# EAGLE board yrl040-bugfix1 (EAGLE 9.4.2), part 1 of 2
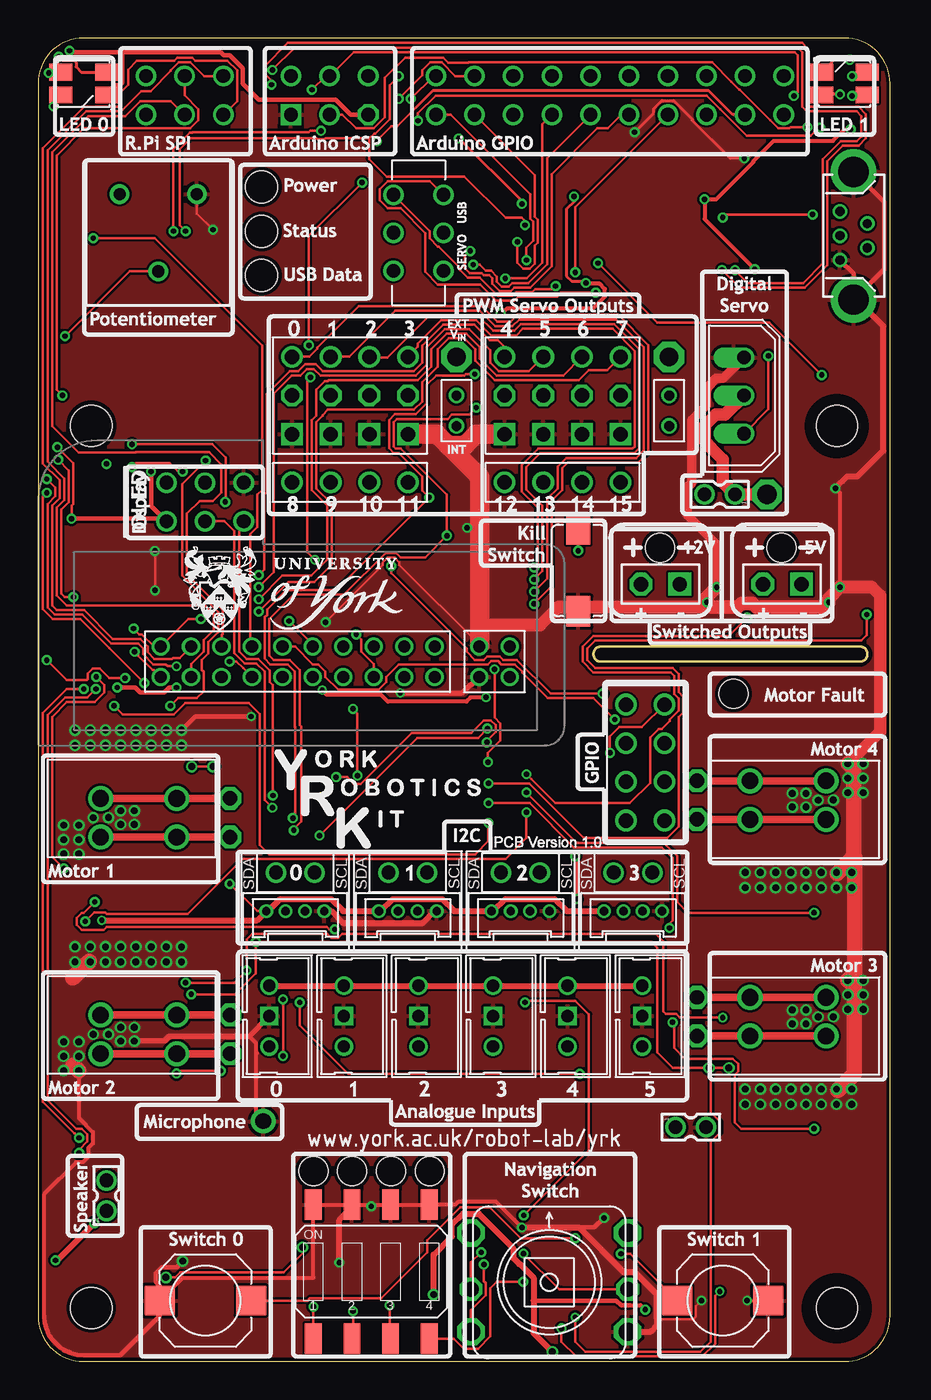
[diagram p4: board, top side]
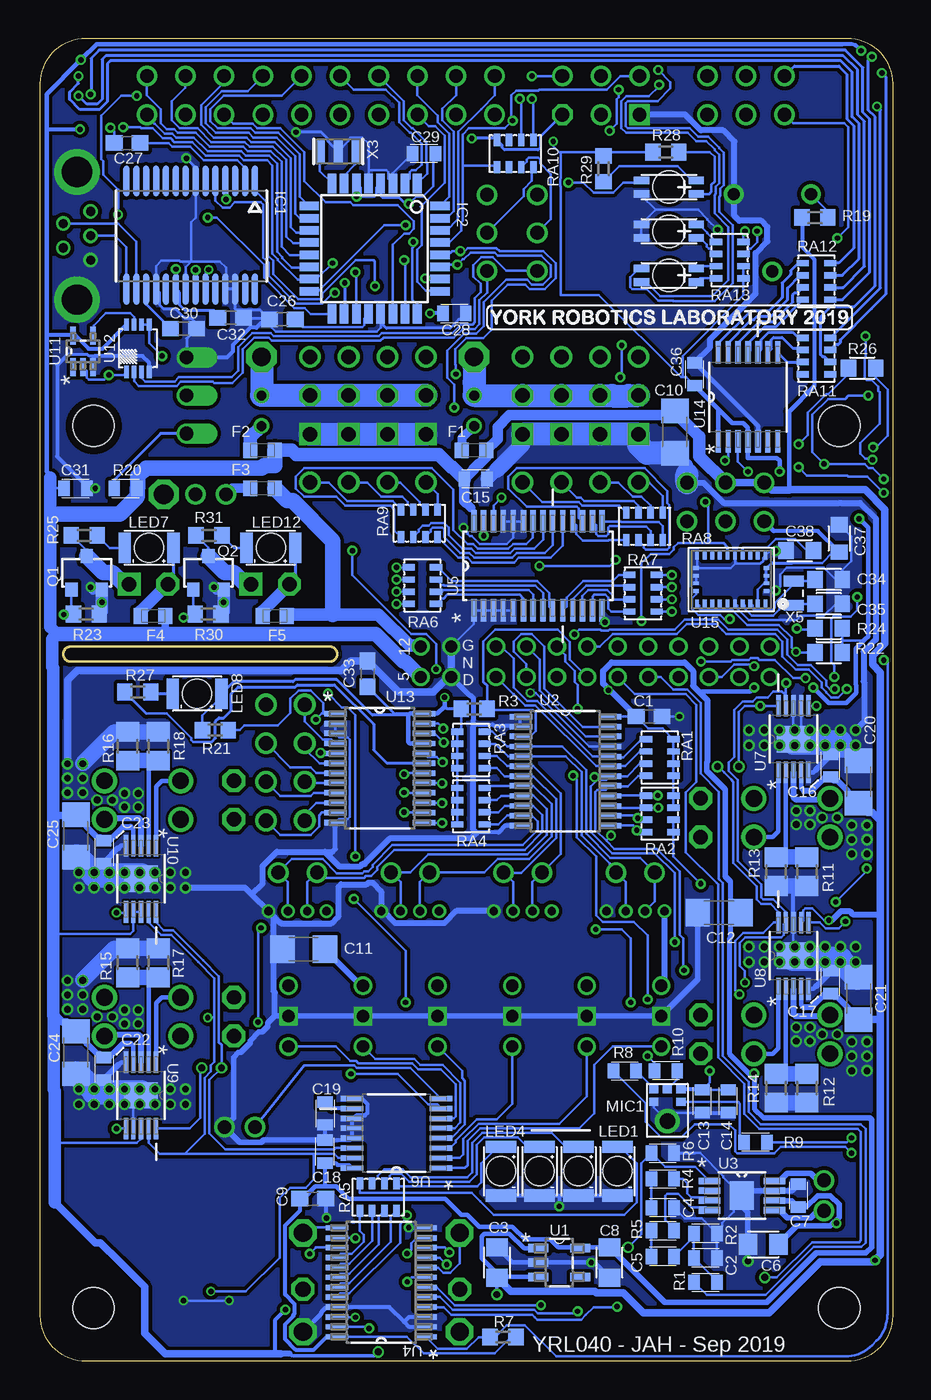
[diagram p5: board, bottom side, seen from below]

Size 56 x 87 mm. Coordinates in mm from the lower left corner, seen from the top.
Outline: 53,0 arc90 56,3 56,84 arc90 53,87 3,87 arc90 0,84 0,3 arc90 3,0 53,0
Outline: 37,46 54,46 arc180 54,47 37,47 arc180 37,46
Copper layers (1*16): Top 0.018mm / dielectric 1.55mm / Bottom 0.018mm
Design rules "eC_2Layer_PClass6_BaseCopperO18_eCDefault": minimum track width 0.15mm, minimum drill 0.35mm, track to track 0.15mm, track to pad 0.15mm, pad to pad 0.15mm, via to via 0.15mm, smd to smd 0mil, copper to edge 0.25mm, drill to drill 0.35mm, minimum pad ring 0.175mm, minimum via ring 0.125mm, stop-mask expansion 0mil, vias tented up to drill 0.45mm, thermal gap 0.2mm
Holes 2.7 mm at 3.5,61.5 3.5,3.5 52.5,3.5 52.5,61.5
bKeepout: area 39.8,0 to 49.2,14.6
tRestrict: area 2.2,2.2 to 4.8,4.8; area 2.7,60.7 to 4.3,62.3; area 51.5,60.5 to 53.5,62.5; area 51.3,2.3 to 53.7,4.7
bRestrict: area 51,1.9 to 54,5; area 2,2 to 5,5; area 51.7,60.7 to 53.3,62.3; area 1.9,59.9 to 5.1,63.1; area 1.9,1.9 to 5,5

## Footprints (pad centres in the part's own frame; a part is rotated, then mirrored left to right if it is on the bottom)
C0603 = smd 1.1 x 1: 1 -0.85,0; 2 0.85,0
0603-RESISTOR = smd 0.75 x 1: 1 -0.75,0; 2 0.75,0
0805 = smd 1.2 x 1.4: P$1 -1,0; P$2 1,0
C1206 = smd 1.6 x 1.8: 1 -1.4,0; 2 1.4,0
0603 = smd 1 x 1.1: P$1 -0.9,0; P$2 0.9,0
0603-1608X90N = smd 0.95 x 1: 1 -0.8,0; 2 0.8,0
SSOP28 = smd 0.381 x 2.032: 1 0,0; 2 0.65,0; 3 1.3,0; 4 1.95,0; 5 2.6,0; 6 3.25,0; 7 3.9,0; 8 4.55,0; 9 5.2,0; 10 5.85,0; 11 6.5,0; 12 7.15,0; 13 7.8,0; 14 8.45,0; 15 8.45,7.112; 16 7.8,7.112; 17 7.15,7.112; 18 6.5,7.112; 19 5.85,7.112; 20 5.2,7.112; 21 4.55,7.112; 22 3.9,7.112; 23 3.25,7.112; 24 2.6,7.112; 25 1.95,7.112; 26 1.3,7.112; 27 0.65,7.112; 28 0,7.112
TQFP32-08 = smd 1.27 x 0.559: 1 -4.293,2.8; 2 -4.293,2; 3 -4.293,1.2; 4 -4.293,0.4; 5 -4.293,-0.4; 6 -4.293,-1.2; 7 -4.293,-2; 8 -4.293,-2.8; 17 4.293,-2.8; 18 4.293,-2; 19 4.293,-1.2; 20 4.293,-0.4; 21 4.293,0.4; 22 4.293,1.2; 23 4.293,2; 24 4.293,2.8 | smd 0.559 x 1.27: 9 -2.8,-4.293; 10 -2,-4.293; 11 -1.2,-4.293; 12 -0.4,-4.293; 13 0.4,-4.293; 14 1.2,-4.293; 15 2,-4.293; 16 2.8,-4.293; 25 2.8,4.293; 26 2,4.293; 27 1.2,4.293; 28 0.4,4.293; 29 -0.4,4.293; 30 -1.2,4.293; 31 -2,4.293; 32 -2.8,4.293
CONNECTOR-PAIRS = drill 0.8: AUDIO -14.94,-1; AUDIO_ON -12.94,-1; CE0 -18.94,-1; CE1 -16.94,1; GND1 -2,-1; GND2 -2,1; GPIO5 -16.94,-1; GPIO6 -14.94,1; GPIO13 -12.94,1; GPIO21 -10.94,-1; I2S_B -10.94,1; I2S_D -8.94,1; I2S_W -8.94,-1; MISO -20.94,-1; MOSI -20.94,1; RXD -22.94,-1; SCL -6.94,1; SCL_UC -4.94,1; SCLK -18.94,1; SDA -6.94,-1; SDA_UC -4.94,-1; TXD -22.94,1; V5 0,-1; V12 0,1
PICOBLADE-4PIN-9733060-2 = drill 0.55 pad 0.9: GND_1 1.905,0; SCL_1 0.635,0; SDA_1 -0.635,0; V+_1 -1.905,0 | drill 0.9 pad 1.25: SCL_3 1.27,2.54; SDA_3 -1.27,2.54
YRL012-EXPORTED_I2C_PI_OLED = drill 0.9: 3V3 14.732,26.162; 5V-1 17.272,26.162; 5V-2 17.272,23.622; GND 17.272,21.082; SCL 14.732,21.082; SDA 14.732,23.622
SERVO_BLOCK_8X2 = drill 0.65 pad 1.016: +5V 7,-2; +5V1 20.97,-2; V_INT_JUMPER 7,0; V_INT_JUMPER1 20.97,0 | drill 0.95 square: GND1 -3.81,-2.54; GND2 -1.27,-2.54; GND3 1.27,-2.54; GND4 3.81,-2.54; GND5 10.16,-2.54; GND6 12.7,-2.54; GND7 15.24,-2.54; GND8 17.78,-2.54 | drill 0.95: PWM1 -3.81,2.54; PWM2 -1.27,2.54; PWM3 1.27,2.54; PWM4 3.81,2.54; PWM5 10.16,2.54; PWM6 12.7,2.54; PWM7 15.24,2.54; PWM8 17.78,2.54; PWM9 -3.81,-5.715; PWM10 -1.27,-5.715; PWM11 1.27,-5.715; PWM12 3.81,-5.715; PWM13 10.16,-5.715; PWM14 12.7,-5.715; PWM15 15.24,-5.715; PWM16 17.78,-5.715 | drill 0.95 octagon: V+1 -3.81,0; V+2 -1.27,0; V+3 1.27,0; V+4 3.81,0; V+5 10.16,0; V+6 12.7,0; V+7 15.24,0; V+8 17.78,0 | drill 1.2 pad 2 octagon: V_EXT 7,2.54; V_EXT1 20.97,2.54
WAGO-233-502 = drill 1.1 pad 1.5: P1-A -2.5,-1.27; P1-B 2.5,-1.27; P2-A -2.5,1.27; P2-B 2.5,1.27 | drill 0.95 pad 1.5 octagon: P1-C 6,-1.27; P2-C 6,1.27
JST-3PIN-PH = drill 0.8 pad 1.2: 1-VO 4,0; 3-VCC 0,0 | drill 0.8 pad 1.2 square: 2-GND 2,0
MINIUSB-VERT-1841175 = drill 0.6 pad 0.95: 1 0.9,-1.6; 2 -0.9,-0.8; 3 0.9,0; 4 -0.9,0.8; 5 0.9,1.6 | drill 2 pad 2.5: 6 0,-4.2; 7 0,4.2
2X10-PIN-ARDUINO = drill 0.9 pad 1.3: +3V3 20.32,-2.54; A0 0,-2.54; A1 2.54,-2.54; A2 5.08,-2.54; A3 7.62,-2.54; A4 10.16,-2.54; A5 12.7,-2.54; A6 15.24,-2.54; A7 17.78,-2.54; CE0 -16.51,0; CE1 -19.05,-2.54; D0 0,0; D1 2.54,0; D2 5.08,0; D3 7.62,0; D4 10.16,0; D5 12.7,0; D6 15.24,0; D7 17.78,0; D8 20.32,0; D9 22.86,0; D10 22.86,-2.54; D11 -6.985,-2.54; D12 -4.445,0; D13 -6.985,0; LED -19.05,0; MISO -13.97,0; MOSI -13.97,-2.54; RST -9.525,0; SCLK -16.51,-2.54 | drill 0.9 pad 1.3 octagon: +5V -4.445,-2.54 | drill 0.9 pad 1.3 square: GND -9.525,-2.54
VIN_PIN = drill 1.3 pad 1.9 octagon: P$1 0,0
MOLEX-3PIN-9979620 = drill 0.9 offset: P$1 0,0; P$2 0,-2.5; P$3 0,-5
4X2X0.1"-GPIO = drill 0.95 pad 1.422: GPIO0 -1.27,5.08; GPIO1 1.27,5.08; GPIO2 -1.27,2.54; GPIO3 1.27,2.54; GPIO4 -1.27,0; GPIO5 1.27,0; GPIO6 -1.27,-2.54; GPIO7 1.27,-2.54
2-PIN-SPO = drill 0.95 pad 1.5 octagon: V+ -1.27,0 | drill 0.95 pad 1.5 square: V- 1.27,0
KPTL-SERIES-REVERSE-SMD-LED = smd 0.8 x 2: ANODE -1.6,0; CATHODE 1.6,0 | hole 1.9: 0,0
2401105-RGB-LED = smd 1.1 x 1.5: 1 -0.75,-1.5; 2 -0.75,1.5; 3 0.75,1.5; 4 0.75,-1.5
SML-825X-SERIES = smd 1 x 0.5: 1-RED_ANODE 1.8,0.45; 2_RED-CATHODE -1.8,0.45; 3-GREEN-ANODE 1.8,-0.45; 4-GREEN-CATHODE -1.8,-0.45 | hole 2.1: 0,0
MICROBUILDER_SPH0645LM4H = smd 0.6 x 0.525: 1 -0.9,1.4; 2 -0.9,0.55; 4 0.9,0.55; 5 0.9,1.4; 6 0,1.4 | drill 1.025 pad 1.625: 3 0,-0.71
BSR802N-NMOS = smd 0.8 x 0.9: 1-G -1,-1.1; 2-S 1,-1.1; 3-D 0,1.1
R0603 = smd 1 x 1.1: 1 -0.85,0; 2 0.85,0
R0805 = smd 1.3 x 1.5: 1 -0.95,0; 2 0.95,0
1206-RES-ARRAY = smd 0.42 x 0.8: P$1 -1.2,-0.9; P$2 -0.4,-0.9; P$3 0.4,-0.9; P$4 1.2,-0.9; P$5 1.2,0.9; P$6 0.4,0.9; P$7 -0.4,0.9; P$8 -1.2,0.9
PSISWARM15LIBRARYPSI-SWARM-1-5_01-ROBOT_4WAYDIL-MCEMR-04-T = smd 1.1 x 2: 1 -3.81,-4.4; 2 -1.27,-4.4; 3 1.27,-4.4; 4 3.81,-4.4; 5 3.81,4.4; 6 1.27,4.4; 7 -1.27,4.4; 8 -3.81,4.4
PCB_SWITCH = smd 2 x 2: P$1 -3,0; P$2 3,0
PSISWARM15LIBRARYPSI-SWARM-1-5_01-ROBOT_ALPS-SKQUCAA010 = drill 1.2 octagon: P1 -5.15,3.25; P3 -5.15,-3.25; P4 5.15,-3.25; P6 5.15,3.25 | drill 1 octagon: P2 -5.15,-0.45; P5 5.15,-0.45
DPDT-SWITCH-2320018 = drill 0.9: A_1 -2.5,1.65; A_2 2.5,1.65; A_COM 0,1.65; B_1 -2.5,-1.65; B_2 2.5,-1.65; B_COM 0,-1.65
6X3.5-SWITCH = smd 2 x 1.6: 1 -2.7,0; 2 2.7,0
SOT95P270X145-5N = smd 1.321 x 0.559: 1 -1.372,0.94; 2 -1.372,0; 3 -1.372,-0.94; 4 1.372,-0.94; 5 1.372,0.94
SOP65P640X120-24N = smd 1.473 x 0.356: 1 -2.921,3.581; 2 -2.921,2.921; 3 -2.921,2.286; 4 -2.921,1.626; 5 -2.921,0.965; 6 -2.921,0.33; 7 -2.921,-0.33; 8 -2.921,-0.965; 9 -2.921,-1.626; 10 -2.921,-2.286; 11 -2.921,-2.921; 12 -2.921,-3.581; 13 2.921,-3.581; 14 2.921,-2.921; 15 2.921,-2.286; 16 2.921,-1.626; 17 2.921,-0.965; 18 2.921,-0.33; 19 2.921,0.33; 20 2.921,0.965; 21 2.921,1.626; 22 2.921,2.286; 23 2.921,2.921; 24 2.921,3.581
SOP65P488X107-9N = smd 1.397 x 0.432: 1 -2.134,0.965; 2 -2.134,0.33; 3 -2.134,-0.33; 4 -2.134,-0.965; 5 2.134,-0.965; 6 2.134,-0.33; 7 2.134,0.33; 8 2.134,0.965 | smd 1.575 x 1.88: 9 0,0
SOP65P640X110-24N = smd 1.473 x 0.356: 1 -2.921,3.581; 2 -2.921,2.921; 3 -2.921,2.286; 4 -2.921,1.626; 5 -2.921,0.965; 6 -2.921,0.33; 7 -2.921,-0.33; 8 -2.921,-0.965; 9 -2.921,-1.626; 10 -2.921,-2.286; 11 -2.921,-2.921; 12 -2.921,-3.581; 13 2.921,-3.581; 14 2.921,-2.921; 15 2.921,-2.286; 16 2.921,-1.626; 17 2.921,-0.965; 18 2.921,-0.33; 19 2.921,0.33; 20 2.921,0.965; 21 2.921,1.626; 22 2.921,2.286; 23 2.921,2.921; 24 2.921,3.581
SOP65P640X110-28N = smd 1.473 x 0.356: 1 -2.921,4.216; 2 -2.921,3.581; 3 -2.921,2.921; 4 -2.921,2.286; 5 -2.921,1.626; 6 -2.921,0.965; 7 -2.921,0.33; 8 -2.921,-0.33; 9 -2.921,-0.965; 10 -2.921,-1.626; 11 -2.921,-2.286; 12 -2.921,-2.921; 13 -2.921,-3.581; 14 -2.921,-4.216; 15 2.921,-4.216; 16 2.921,-3.581; 17 2.921,-2.921; 18 2.921,-2.286; 19 2.921,-1.626; 20 2.921,-0.965; 21 2.921,-0.33; 22 2.921,0.33; 23 2.921,0.965; 24 2.921,1.626; 25 2.921,2.286; 26 2.921,2.921; 27 2.921,3.581; 28 2.921,4.216
SOP65P640X120-16N = smd 1.473 x 0.356: 1 -2.921,2.286; 2 -2.921,1.626; 3 -2.921,0.965; 4 -2.921,0.33; 5 -2.921,-0.33; 6 -2.921,-0.965; 7 -2.921,-1.626; 8 -2.921,-2.286; 9 2.921,-2.286; 10 2.921,-1.626; 11 2.921,-0.965; 12 2.921,-0.33; 13 2.921,0.33; 14 2.921,0.965; 15 2.921,1.626; 16 2.921,2.286
SOP65P640X110-15N = smd 1.422 x 0.279: 1 -2.184,0.991; 2 -2.184,0.508; 3 -2.184,0; 4 -2.184,-0.508; 5 -2.184,-0.991; 6 2.184,-0.991; 7 2.184,-0.508; 8 2.184,0; 9 2.184,0.508; 10 2.184,0.991 | smd 1.727 x 2.184: 11 0,0
SOT65P210X110-5N = smd 1.168 x 0.356: 1 -1.041,0.66; 2 -1.041,0; 3 -1.041,-0.66; 4 1.041,-0.66; 5 1.041,0.66
SN74LVC2G1260DCU = smd 0.3 x 0.8: 1 -0.75,-1.55; 2 -0.25,-1.55; 3 0.25,-1.55; 4 0.75,-1.55; 5 0.75,1.55; 6 0.25,1.55; 7 -0.25,1.55; 8 -0.75,1.55
SOP65P640X120-14N = smd 1.473 x 0.356: 1 -2.921,1.956; 2 -2.921,1.295; 3 -2.921,0.66; 4 -2.921,0; 5 -2.921,-0.66; 6 -2.921,-1.295; 7 -2.921,-1.956; 8 2.921,-1.956; 9 2.921,-1.295; 10 2.921,-0.66; 11 2.921,0; 12 2.921,0.66; 13 2.921,1.295; 14 2.921,1.956
MICROBUILDER_BNO055 = smd 0.25 x 0.475: 1 -2.25,1.562; 6 -2.25,-1.562; 7 -1.75,-1.562; 8 -1.25,-1.562; 9 -0.75,-1.562; 10 -0.25,-1.562; 11 0.25,-1.562; 12 0.75,-1.562; 13 1.25,-1.562; 14 1.75,-1.562; 15 2.25,-1.562; 20 2.25,1.562; 21 1.75,1.562; 22 1.25,1.562; 23 0.75,1.562; 24 0.25,1.562; 25 -0.25,1.562; 26 -0.75,1.562; 27 -1.25,1.562; 28 -1.75,1.562 | smd 0.375 x 0.25: 2 -2.312,0.75; 3 -2.312,0.25; 4 -2.312,-0.25; 5 -2.312,-0.75; 16 2.312,-0.75; 17 2.312,-0.25; 18 2.312,0.25; 19 2.312,0.75
BOURNS-3386F-TRIMPOT = drill 0.8 pad 1.3: P$1 2.54,2.54; P$2 0,-2.54; P$3 -2.54,2.54
CON-MOLEX_87758-0216 = drill 0.9 pad 1.27: 1 0,-1; 2 0,1
RESONATOR = smd 0.6 x 1.4: 1 -1.2,0; 2 0,0; 3 1.2,0
CRYSTAL-2X1.2 = smd 1.3 x 0.7: P$1 0,0.8; P$2 0,-0.8

## Placement (x,y rotation side)
C1  100n  [C0603]  16,42.4 0 bottom
C2  33n  [0603-RESISTOR]  12.3,6.8 180 bottom
C3  4.7uF 0805  [0805]  26,6.5 270 bottom
C4  10n  [0603-RESISTOR]  15.1,10.1 180 bottom
C5  10n  [0603-RESISTOR]  15.1,6.9 180 bottom
C6  4.7uF 0805  [0805]  8.5,7.7 0 bottom
C7  100n  [0603-RESISTOR]  6.2,10.9 270 bottom
C8  4.7uF 0805  [0805]  18.6,6.5 90 bottom
C9  100n  [C0603]  38.1,10.7 180 bottom
C10  10uF+ 1206 10V X5R  [C1206]  14.3,61.1 270 bottom
C11  10uF+ 1206 10V X5R  [C1206]  38.7,27.1 180 bottom
C12  10uF+ 1206 6.3V X5R  [C1206]  11.4,29.5 180 bottom
C13  200p  [0603-RESISTOR]  12.5,17.1 90 bottom
C14  100n  [0603-RESISTOR]  10.8,17.1 90 bottom
C15  100n  [0603-RESISTOR]  27.4,58 180 bottom
C16  100n  [0603-RESISTOR]  4.07,39.17 90 bottom
C17  100n  [0603-RESISTOR]  4.07,24.93 90 bottom
C18  100n  [0603-RESISTOR]  37.3,13.8 90 bottom
C19  100n  [0603-RESISTOR]  37.3,16.3 270 bottom
C20  10uF 10V 1206  [C1206]  2.23,38.1 90 bottom
C21  10uF 10V 1206  [C1206]  2.23,23.86 90 bottom
C22  100n  [0603-RESISTOR]  51.83,19.23 270 bottom
C23  100n  [0603-RESISTOR]  51.83,33.47 270 bottom
C24  10uF 10V 1206  [C1206]  53.67,20.3 270 bottom
C25  10uF 10V 1206  [C1206]  53.67,34.54 270 bottom
C26  100n  [C0603]  40.1,68.5 0 bottom
C27  100n  [C0603]  50.3,80.1 180 bottom
C28  1u  [0603-RESISTOR]  28.8,68.9 0 bottom
C29  100n  [0603-RESISTOR]  30.8,79.4 180 bottom
C30  100n  [C0603]  46.6,67.9 0 bottom
C31  100n  [0603-RESISTOR]  53.7,57.4 0 bottom
C32  100n  [C0603]  43.5,68.6 0 bottom
C33  100n  [C0603]  34.5,45.2 270 bottom
C34  22pF  [0603]  4.2,51.4 180 bottom
C35  22pF  [0603]  4.2,49.8 180 bottom
C36  100n  [0603-RESISTOR]  13,64.9 90 bottom
C37  0.1u  [0603]  3.5,54.1 270 bottom
C38  0.1u  [0603]  6.1,53.3 0 bottom
F1  1A FA 0603  [0603-1608X90N]  27.5,59.9 0 bottom
F2  1A FA 0603  [0603-1608X90N]  41.4,59.9 0 bottom
F3  1A FA 0603  [0603-1608X90N]  41.4,57.4 0 bottom
F4  1A FA 0603  [0603-1608X90N]  48.6,49 180 bottom
F5  1A FA 0603  [0603-1608X90N]  40.6,49 180 bottom
IC1  FT232RL  [SSOP28]  41.9,77.6 180 bottom
IC2  ATMEGA328P-AU  [TQFP32-08]  34.04,73.15 270 bottom
J1  CONNECTOR-PAIRS  [CONNECTOR-PAIRS]  31,46 0 top
J2  I2C-BLOCK-2  [PICOBLADE-4PIN-9733060-2]  16.9,29.6 0 top
J3  I2C-BLOCK-2  [PICOBLADE-4PIN-9733060-2]  24.3,29.6 0 top
J4  I2C-BLOCK-2  [PICOBLADE-4PIN-9733060-2]  31.7,29.6 0 top
J5  I2C-BLOCK-2  [PICOBLADE-4PIN-9733060-2]  39.1,29.6 0 top
J6  YRL012-EXPORTED_ADA-128X32-DISPLAY  [YRL012-EXPORTED_I2C_PI_OLED]  34.6,40.5 90 top
J7  SERVO_CONNECTION_BLOCK  [SERVO_BLOCK_8X2]  20.5,63.5 0 top
J8  WAGO-233-502-TERMINAL  [WAGO-233-502]  6.61,35.74 0 top
J9  WAGO-233-502-TERMINAL  [WAGO-233-502]  6.61,21.5 0 top
J10  SHARP-SENSOR  [JST-3PIN-PH]  15.2,24.7 270 top
J11  SHARP-SENSOR  [JST-3PIN-PH]  20.1,24.7 270 top
J12  SHARP-SENSOR  [JST-3PIN-PH]  25,24.7 270 top
J13  SHARP-SENSOR  [JST-3PIN-PH]  29.9,24.7 270 top
J14  SHARP-SENSOR  [JST-3PIN-PH]  34.8,24.7 270 top
J15  SHARP-SENSOR  [JST-3PIN-PH]  39.7,24.7 270 top
J16  WAGO-233-502-TERMINAL  [WAGO-233-502]  49.29,22.66 180 top
J17  WAGO-233-502-TERMINAL  [WAGO-233-502]  49.29,36.9 180 top
J18  MINI-USB  [MINIUSB-VERT-1841175]  53.6,74 180 top
J19  ARDUINO-CONNECTORS  [2X10-PIN-ARDUINO]  26.15,84.5 0 top
J20  VIN-POINT  [VIN_PIN]  47.9,57 0 top
J21  MOLEX3PIN-9979620  [MOLEX-3PIN-9979620]  46.4,66 0 top
J22  GPIO-8PIN  [4X2X0.1"-GPIO]  39.9,38.1 0 top
J23  SPO-2-PIN-HEADER  [2-PIN-SPO]  48.9,51.1 0 top
J24  SPO-2-PIN-HEADER  [2-PIN-SPO]  40.9,51.1 0 top
LED1  KPTL-SERIES-REVERSE-MOUNT-LED  [KPTL-SERIES-REVERSE-SMD-LED]  18.09,12.5 270 bottom
LED2  KPTL-SERIES-REVERSE-MOUNT-LED  [KPTL-SERIES-REVERSE-SMD-LED]  20.64,12.5 270 bottom
LED3  KPTL-SERIES-REVERSE-MOUNT-LED  [KPTL-SERIES-REVERSE-SMD-LED]  23.2,12.5 270 bottom
LED4  KPTL-SERIES-REVERSE-MOUNT-LED  [KPTL-SERIES-REVERSE-SMD-LED]  25.74,12.5 270 bottom
LED5  2481105-RGB-LED  [2401105-RGB-LED]  3,84 90 top
LED6  2481105-RGB-LED  [2401105-RGB-LED]  53,84 270 top
LED7  KPTL-SERIES-REVERSE-MOUNT-LED  [KPTL-SERIES-REVERSE-SMD-LED]  48.86,53.48 180 bottom
LED8  KPTL-SERIES-REVERSE-MOUNT-LED  [KPTL-SERIES-REVERSE-SMD-LED]  45.7,43.9 180 bottom
LED9  DUAL-COLOUR-REVERSE-MOUNT-LED  [SML-825X-SERIES]  14.7,77.2 0 bottom
LED10  DUAL-COLOUR-REVERSE-MOUNT-LED  [SML-825X-SERIES]  14.7,71.4 0 bottom
LED11  DUAL-COLOUR-REVERSE-MOUNT-LED  [SML-825X-SERIES]  14.7,74.3 0 bottom
LED12  KPTL-SERIES-REVERSE-MOUNT-LED  [KPTL-SERIES-REVERSE-SMD-LED]  40.86,53.48 180 bottom
LOGO1  YRL-2019-LOGO  [YRL2019-LOGO]  26.7,67.8 0 bottom
MIC1  MICROBUILDER_MIC_I2S_SPH0645  [MICROBUILDER_SPH0645LM4H]  14.8,16.5 0 bottom
Q1  BSR802N-MOSFET-2443469  [BSR802N-NMOS]  52.96,51.84 0 bottom
Q2  BSR802N-MOSFET-2443469  [BSR802N-NMOS]  44.96,51.84 0 bottom
R1  270  [0603-RESISTOR]  12.3,5.2 0 bottom
R2  150  [0603-RESISTOR]  12.3,8.4 180 bottom
R3  4.7k  [R0603]  27.5,42.9 180 bottom
R4  20K  [0603-RESISTOR]  15.1,12 0 bottom
R5  20K  [0603-RESISTOR]  15.1,8.6 0 bottom
R6  100K  [0603-RESISTOR]  15.1,13.7 0 bottom
R7  10K  [R0603]  25.6,1.6 0 bottom
R8  51  [0603-RESISTOR]  17.6,19.1 0 bottom
R9  51  [0603-RESISTOR]  9,14.4 180 bottom
R10  51  [0603-RESISTOR]  14.9,19.1 180 bottom
R11  500m  [R0805]  5.63,32.2 90 bottom
R12  500m  [R0805]  5.63,17.96 90 bottom
R13  500m  [R0805]  7.65,32.2 90 bottom
R14  500m  [R0805]  7.65,17.96 90 bottom
R15  500m  [R0805]  50.27,26.2 270 bottom
R16  500m  [R0805]  50.27,40.44 270 bottom
R17  500m  [R0805]  48.25,26.2 270 bottom
R18  500m  [R0805]  48.25,40.44 270 bottom
R19  100K  [R0603]  5.1,75.2 0 bottom
R20  10K  [0603-RESISTOR]  50.4,57.4 0 bottom
R21  10K  [R0603]  44.5,41.5 180 bottom
R22  10K  [0603]  4.2,46.6 0 bottom
R23  10K  [R0603]  52.98,49.14 180 bottom
R24  10K  [0603]  4.2,48.2 0 bottom
R25  1K  [R0603]  53.12,54.3 0 bottom
R26  10K  [0603]  2,65.3 0 bottom
R27  220  [R0603]  49.6,44 0 bottom
R28  470  [R0603]  14.9,79.5 180 bottom
R29  470  [R0603]  19,78.4 90 bottom
R30  10K  [R0603]  44.98,49.14 180 bottom
R31  1K  [R0603]  44.92,54.3 0 bottom
RA1  2k2  [1206-RES-ARRAY]  15.3,39.7 90 bottom
RA2  2k2  [1206-RES-ARRAY]  15.3,36 90 bottom
RA3  2k2  [1206-RES-ARRAY]  27.7,40.2 90 bottom
RA4  2k2  [1206-RES-ARRAY]  27.7,36.5 90 bottom
RA5  1K  [1206-RES-ARRAY]  33.8,10.8 0 bottom
RA6  220  [1206-RES-ARRAY]  30.9,51 90 bottom
RA7  220  [1206-RES-ARRAY]  16.4,50.5 270 bottom
RA8  220  [1206-RES-ARRAY]  16.3,54.9 180 bottom
RA9  220  [1206-RES-ARRAY]  31.1,55.1 180 bottom
RA10  1K  [1206-RES-ARRAY]  24.8,79.4 180 bottom
RA11  100  [1206-RES-ARRAY]  5,66.1 90 bottom
RA12  100  [1206-RES-ARRAY]  5,71 90 bottom
RA13  1K  [1206-RES-ARRAY]  10.7,72.4 90 bottom
SCREEN1  YRK-SCREEN-2  [SILKSCREEN-V1]  0.2,0.2 0 top
SW1  PSISWARM15LIBRARYPSI-SWARM-1-5_01-ROBOT_4-WAY-DIP-1524007-MCEMR-04-T  [PSISWARM15LIBRARYPSI-SWARM-1-5_01-ROBOT_4WAYDIL-MCEMR-04-T]  21.9,5.9 0 top
SW2  PUSH-SWITCH-EVPAS-SERIES  [PCB_SWITCH]  11,4 180 top
SW3  PUSH-SWITCH-EVPAS-SERIES  [PCB_SWITCH]  45,4 0 top
SW4  PSISWARM15LIBRARYPSI-SWARM-1-5_01-ROBOT_5-WAY-SWITCH  [PSISWARM15LIBRARYPSI-SWARM-1-5_01-ROBOT_ALPS-SKQUCAA010]  33.6,5.2 0 top
SW5  DPDT-SWITCH-2320018  [DPDT-SWITCH-2320018]  25,74.2 270 top
SW6  SWITCH-9471898  [6X3.5-SWITCH]  35.5,52 270 top
U1  MCP1824T-3302E/OT  [SOT95P270X145-5N]  21.9,6.5 0 bottom
U2  PCA9548APWR  [SOP65P640X120-24N]  21.5,38.8 0 bottom
U3  TPA2005D1DGN  [SOP65P488X107-9N]  9.9,10.9 0 bottom
U4  PCA9555PW,118  [SOP65P640X110-24N]  33.6,5.2 180 bottom
U5  PCA9685PW  [SOP65P640X110-28N]  23.3,52.3 90 bottom
U6  ADS7830IPWTG4  [SOP65P640X120-16N]  32.6,15 180 bottom
U7  DRV8830DGQR  [SOP65P640X110-15N]  6.51,40.91 90 bottom
U8  DRV8830DGQR  [SOP65P640X110-15N]  6.51,26.67 90 bottom
U9  DRV8830DGQR  [SOP65P640X110-15N]  49.39,17.49 270 bottom
U10  DRV8830DGQR  [SOP65P640X110-15N]  49.39,31.73 270 bottom
U11  SN74AHCT1G04DCKT  [SOT65P210X110-5N]  53.2,66.4 90 bottom
U12  SN74LVC2G126DCUT-1741035  [SN74LVC2G1260DCU]  49.6,66.6 0 bottom
U13  PCA9555PW,118  [SOP65P640X110-24N]  33.7,39 0 bottom
U14  TCA6507PW  [SOP65P640X120-14N]  9.5,63.4 90 bottom
U15  BNO055  [MICROBUILDER_BNO055]  10.6,51.4 180 bottom
VR1  3386F-TRIMPOT-9354581  [BOURNS-3386F-TRIMPOT]  7.9,74.2 0 top
X1  CON-MOLEX_87758-0216  [CON-MOLEX_87758-0216]  4.5,10.9 0 top
X2  CON-MOLEX_87758-0216  [CON-MOLEX_87758-0216]  42.9,15.4 270 top
X3  CSTCE16 16MHz Res.  [RESONATOR]  36.43,79.54 180 bottom
X4  CON-MOLEX_87758-0216  [CON-MOLEX_87758-0216]  44.8,57 90 top
X5  CRYSTAL-2X1.2  [CRYSTAL-2X1.2]  6.5,50.5 0 bottom

## Tracks (layer width: path | path; a pad name or v marks a point on that pad's centre or on a via)
3V3_USB
  Bottom 0.2: C30.1 49.05,69.5 IC1.17
!DIRECTION
  Bottom 0.15: U11.4 52.5,67.48 52.5,68.1 51.7,68.9 50.1,68.9 49.85,68.65 U12.7
!RESET_I2C
  Bottom 0.15: U2.3 23.82,41.09 23.46,41.45 23.46,42.65 23.63,42.83 26.57,42.83 R3.1 26.65,44.42 26.89,44.66 26.89,47.34 26.1,48.12 22.02,48.12 21.2,47.31 21.2,46.14 J1.GPIO21
!RESET_IMU  (via drill 0.35 pad 0.65)
  Top 0.15: v16.5,48.67 18.06,47.12 J1.GPIO13 | v6.17,60.3 11.45,60.3 12.34,59.41 12.34,56.54 v12.3,56.5
  Bottom 0.15: U15.11 10.85,53.55 11.1,53.8 12.1,53.8 | 12.1,53.8 14.1,53.8 14.37,53.53 14.37,53.38 14.67,53.08 15.9,53.08 16.5,52.48 v16.5,48.67 | 12.1,53.8 12.1,56.3 v12.3,56.5 | R26.P$1 2.9,64.89 4.22,63.58 4.36,63.58 5.58,62.36 5.58,60.9 v6.17,60.3
+3V3  (via drill 0.35, 0.35 pad 0.65)
  Top 0.15: v9.1,18.93 9.27,19.1 v12.01,19.1 | 24.84,82.44 23.6,81.2 23.22,81.2 22.3,80.28 v22.3,80.2 | v2.2,55.4 2.2,56.25 2.33,56.38 2.33,59.05 v1.27,60.1
  Top 0.2: J19.+3V3 45.66,81.96 44.08,83.53 25.93,83.53 24.84,82.44
  Top 0.254: v29.44,43.66 28.43,43.66 28.14,43.37 23,43.37 22.55,43.82 18.98,43.82 v18.67,44.13
  Top 0.3: v7.42,58.5 7.42,56.24 J6.3V3 8.27,55.4 v2.2,55.4 | v9.1,44.3 8.63,44.3 8.31,43.98 6.73,43.98 6.4,44.3 5.98,44.3 5.46,44.3 v5.21,44.3
  Bottom 0.15: U4.24 31.91,1.62 30.82,0.53 26.16,0.53 25.08,1.6 R7.2 | U2.24 18.56,42.4 C1.1 16.05,41.6 15.1,41.6 RA1.P$4 RA1.P$3 RA1.P$2 RA1.P$1 RA2.P$4 RA2.P$3 | C12.1 10.46,29.5 10.66,29.7 | RA4.P$8 RA4.P$7 RA4.P$6 RA4.P$5 RA3.P$8 RA3.P$7 RA3.P$6 RA3.P$5 28.35,41.65 R3.2 | 12.17,39.46 12.17,39.42 12.2,39.39 | v12.01,19.1 12.01,18.34 C13.2 C14.2 | 9.5,19 9.17,19 v9.1,18.93 | LED8.ANODE 44.42,43.58 44.42,43.37 45.35,42.45 R21.2 | U15.28 8.85,50.74 8.29,51.3 | C37.P$2 3.93,53.2 4.63,52.5 6.6,52.5 | R24.P$2 3.3,47.4 | 3.3,47.4 R22.P$2 | 3.3,47.4 1.87,47.4 1.78,47.48 | R26.P$2 1.1,64.67 0.33,63.9 0.33,60.85 1.07,60.1 v1.27,60.1 | v22.3,80.2 22.3,79.9 21.9,79.5 | 12.88,64.03 13.55,64.7 13.8,64.7 | 21.9,79.5 21.8,79.4 21.8,77.78 21.85,77.73 21.85,77.27 21.8,77.22 21.8,70.1 19.3,70.1 13.9,64.7 13.8,64.7 | RA13.P$2 RA13.P$1 9.8,70.1 13.8,66.1 13.8,64.7 | R28.2 18.6,79.5 | 18.6,79.5 21.9,79.5 | R29.2 18.85,79.25 18.6,79.5
  Bottom 0.2: R3.2 29.25,42.9 29.41,43.05 29.41,43.62 v29.44,43.66 | LED8.ANODE 43.3,44.7 39.39,44.7 39.27,44.83 36.53,44.83 34.19,42.48 31.82,42.48 | C33.2 32.75,42.6 31.7,42.6 | U15.3 8.29,51.3 U15.4 U15.5 7.94,52.5 6.6,52.5
  Bottom 0.254: C9.2 38.95,9.91 39.93,8.94 39.93,4.4 39.3,3.77 39.3,3.15 39.38,3.07 39.38,2.98 39.93,2.44 39.93,1.46 39.24,0.77 38.03,0.77 37.18,1.62 U4.24 | U6.16 35.73,12.92 36.47,12.92 36.6,13.05 C18.1 37.3,11.5 | v18.67,44.13 18.67,44.22 18.77,44.33 | C13.2 12.55,17.9 MIC1.5 | C37.P$2 4.9,54.6 7.81,54.6
  Bottom 0.3: C36.1 12.88,64.03 11.46,62.61 | 11.46,62.61 U14.1 | 11.46,62.61 10.55,61.7 9.8,61.7 9.5,61.4 U14.4 9.5,59.4 | 1.61,54.31 1.61,54.81 v2.2,55.4 | 2.41,46.7 2.41,44.49 2.38,44.46 2.38,43.94 3.04,43.27 4.18,43.27 v5.21,44.3 | v9.1,44.3 9.35,44.05 12.75,44.05
  Bottom 0.305: C8.P$2 20.47,7.5 | 20.47,7.5 U1.5 | C9.2 38.73,10.7 37.92,11.5 37.3,11.5 36.58,11.5 35.77,10.7 34.66,10.7 29.4,10.7 28.35,9.65 27.95,9.65 27.16,8.86 24.99,8.86 24.15,8.02 22.49,8.02 21.96,7.5 20.47,7.5 | 7.81,54.6 J6.3V3 | 2.41,46.7 2.41,46.86 1.78,47.48 1.61,47.66 1.61,54.31 | v29.44,43.66 29.44,43.05 29.91,42.58 U13.24 30.8,42.6 31.7,42.6 31.82,42.48 31.82,40.72 31.73,40.63 U13.21 | v7.42,58.5 7.42,59.23 7.6,59.4 9.5,59.4
  Bottom 0.34: 10.66,31.54 10.66,29.7 10.66,27.86 10.72,27.8 10.72,20.23 9.5,19 9.05,18.55 9.05,16.55 8.49,16 8.4,16
  Bottom 0.35: C8.P$2 14.97,3.88 8.25,3.88 5,7.12 1.75,7.12 1.38,7.5 1.38,15.88 1.5,16 8.4,16 | 12.2,39.39 12.2,38.81 11.01,37.62 11.01,31.88 10.66,31.54
  Bottom 0.406: C1.1 18.77,44.33 19.01,44.56 19.01,45.4 18.45,45.95 13.66,45.95 13.11,45.4 13.11,44.41 12.75,44.05 12.17,43.47 12.17,39.46
+5V  (via drill 0.35, 0.35 pad 0.65, 0.45 pad 0.75)
  Top 0.15: v12.6,31.4 14.4,29.6 J2.V+_1
  Top 0.2: LED6.1 52.31,85.56 v53.34,85.56 | v35.22,76.58 35.22,76.26 34.73,75.76 34.73,71.36 35.06,71.03 35.88,71.03 v36,70.9
  Top 0.203: v31.8,76.1 31.8,76.3 v27.65,80.4